# Altium schematic sheet Power.SchDoc
size 381 x 241 mm; SheetNumber: 1; SheetTotal: 2
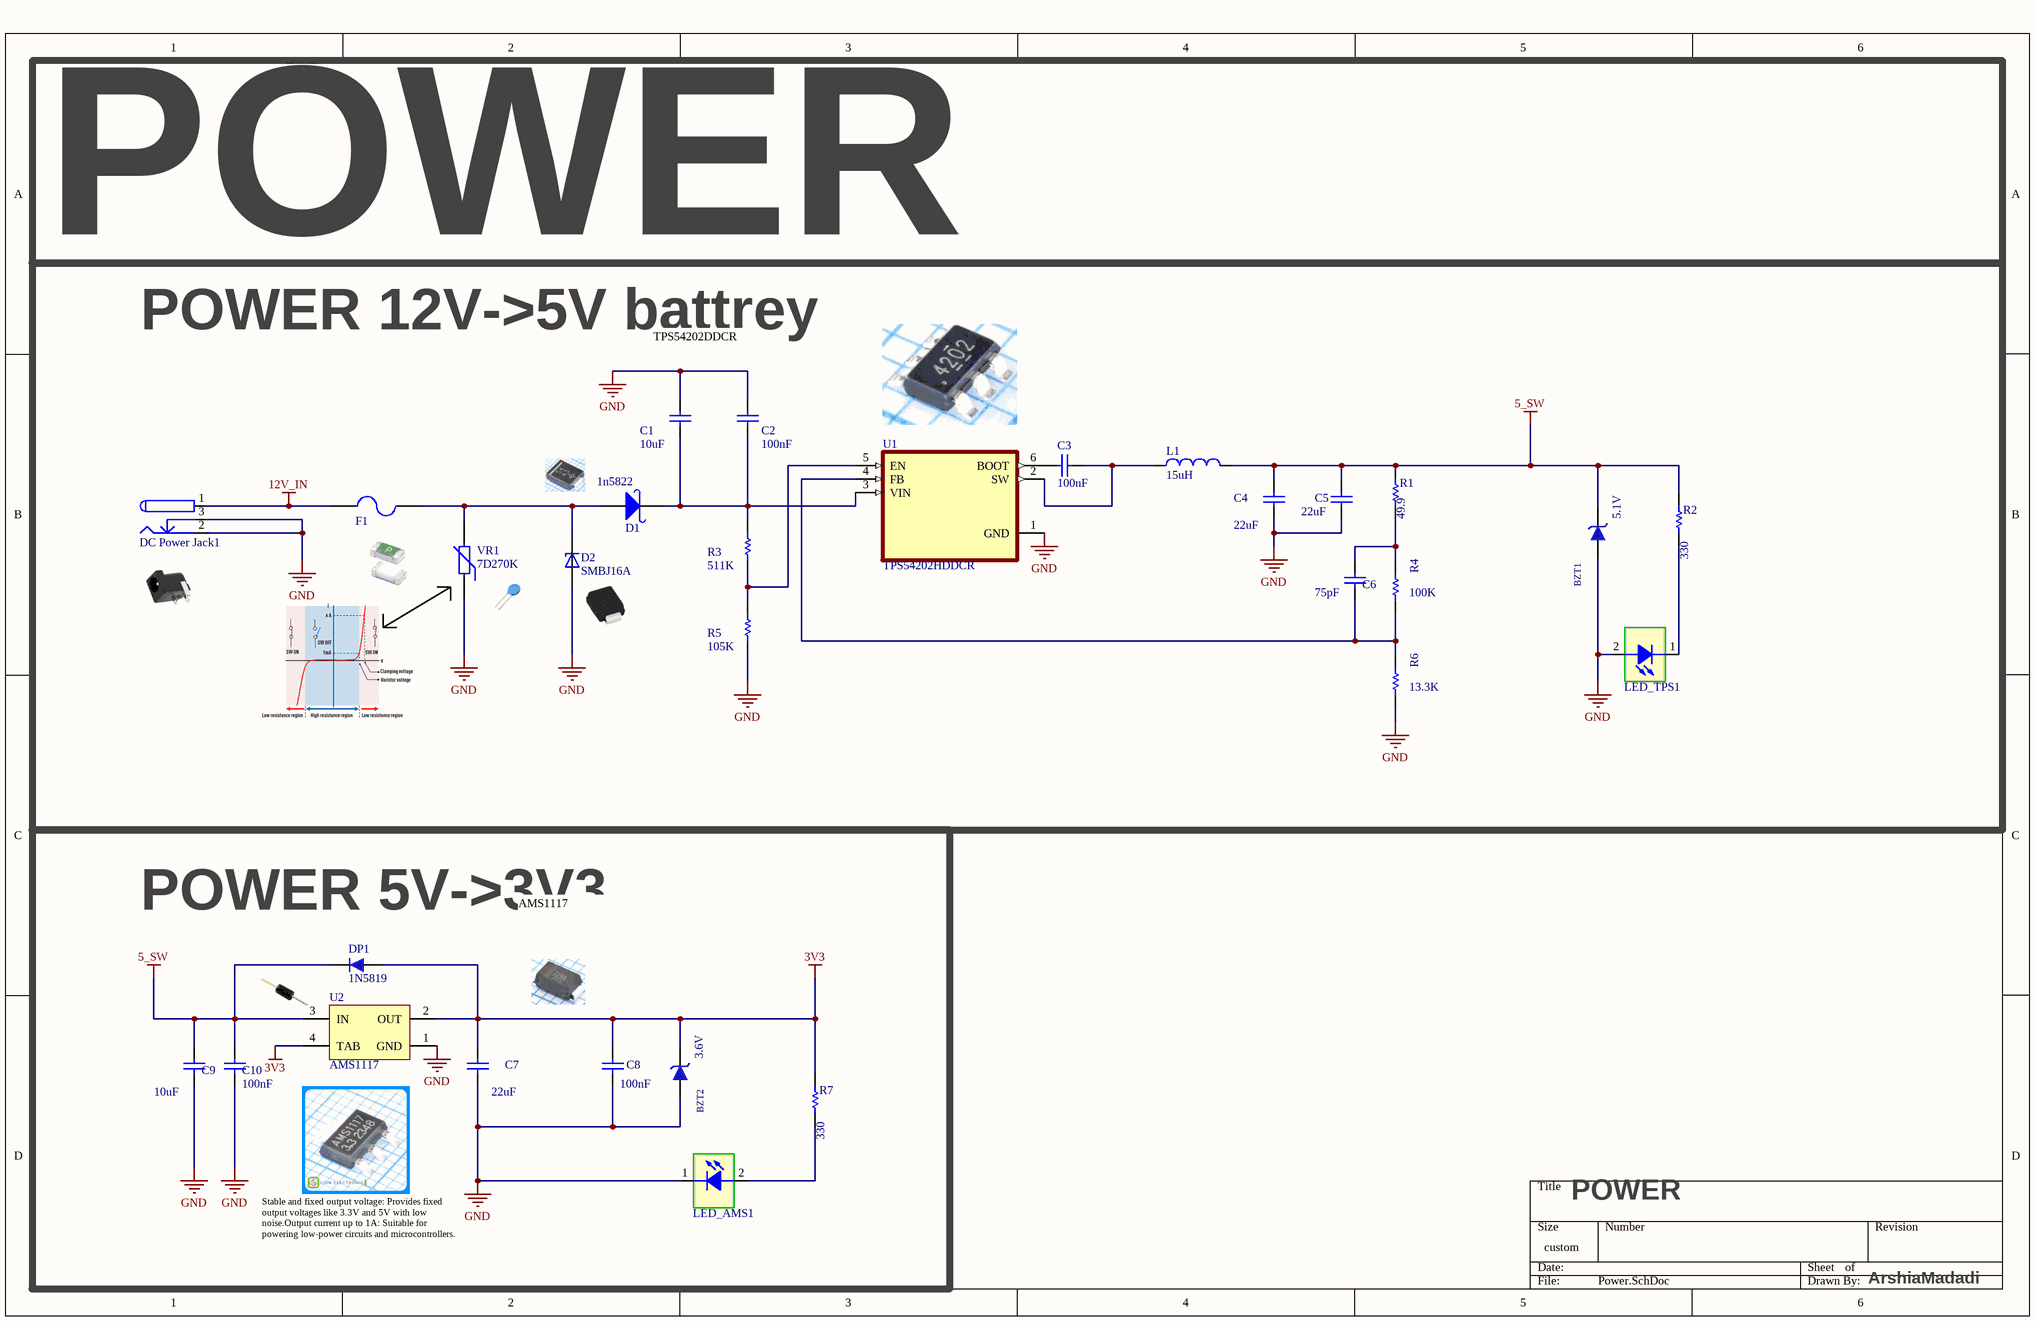
[diagram p0: Power.SchDoc]

## Parts
BZT1  5.1V  [SOD123]
BZT2  3.6V  [SOD123]
C1  10uF  [MY_CAP_SMD_0603]
C2  100nF  [MY_CAP_SMD_0603]
C3  100nF  [MY_CAP_SMD_0603]
C4  22uF  [MY_CAP_SMD_0603]
C5  22uF  [MY_CAP_SMD_0603]
C6  75pF  [MY_CAP_SMD_0603]
C7  22uF  [MY_CAP_SMD_0603]
C8  100nF  [MY_CAP_SMD_0603]
C9  10uF  [MY_CAP_SMD_0603]
C10  100nF  [MY_CAP_SMD_0603]
D1  1n5822  [DO-214AB(SMC)]
D2  SMBJ16A  [DIOM4336X265N]
DC_Power_Jack1  DC Power Jack  [DC Power Jack 1]  (value not drawn)
DP1  1N5819  [430X270D]
F1  F=3.0 A  [1206 FUSE]  (value not drawn)
L1  15uH  [INDUCTOR_SMD_3A]
LED_AMS1  SMD 1206 LED  [LED 1206]  (value not drawn)
LED_TPS1  SMD 1206 LED  [LED 1206]  (value not drawn)
R1  49.9  [RESC3413X04N]
R2  330  [RESC3413X04N]
R3  511K  [RESC3413X04N]
R4  100K  [RESC3413X04N]
R5  105K  [RESC3413X04N]
R6  13.3K  [RESC3413X04N]
R7  330  [RESC3413X04N]
U1  TPS54202HDDCR  [SOT95P280X110-6N]
U2  AMS1117  [SOT223_M]
VR1  7D270K  [07D XXX]

## Blocks framed on the sheet
POWER: BZT1 C1-C6 D1 D2 DC_Power_Jack1 F1 L1 LED_TPS1 R1-R6 U1 VR1
POWER 5V->3V3: BZT2 C7-C10 DP1 LED_AMS1 R7 U2

## Nets
3V3: BZT2.2 C7.1 C8.1 DP1.1 R7.2 U2.2(OUT) U2.4(TAB)
5_SW: BZT1.2 C4.1 C5.1 C9.1 C10.1 DP1.2 L1.2 R1.2 R2.2 U2.3(IN)
12V_IN: DC_Power_Jack1.1 F1.1
GND: BZT1.1 BZT2.1 C1.1 C2.1 C4.2 C5.2 C7.2 C8.2 C9.2 C10.2 D2.A DC_Power_Jack1.2 DC_Power_Jack1.3 LED_AMS1.1 LED_TPS1.2 R5.2 R6.2 U1.1(GND) U2.1(GND) VR1.1
NetC1_2: C1.2 C2.2 D1.2(K) R3.1 U1.3(VIN)
NetC3_1: C3.1 U1.6(BOOT)
NetC3_2: C3.2 L1.1 U1.2(SW)
NetC6_1: C6.1 R1.1 R4.1
NetC6_2: C6.2 R4.2 R6.1 U1.4(FB)
NetD1_1: D1.1(A) D2.C F1.2 VR1.2
NetLED_AMS1_2: LED_AMS1.2 R7.1
NetLED_TPS1_1: LED_TPS1.1 R2.1
NetR3_2: R3.2 R5.1 U1.5(EN)

## Notes on the sheet
- POWER 12V->5V battrey
- TPS54202DDCR
- AMS1117
- POWER
- Stable and fixed output voltage: Provides fixed output voltages like 3.3V and 5V with low noise.Output current up to 1A: Suitable for powering low-power circuits and microcontrollers.
- ArshiaMadadi

## Library data of the parts
BZT1 BZT2 = ZENER GENERAL DIODE: DIODE ZENER GENERAL; VALUE: 12V; Published: 2017-1-12; PackageVersion: 2017-1-12; PackageReference: DO 35; Publisher: Abbas Basereh; PackageDescription: DIODE GEN ZENER; ComponentLink1Description: Manufacturer Link; ComponentLink2Description: Datasheet
C1-C10 = CAP SMD_0603
D1 = 1N5822 SMD: Schottky Rectifiers; Part. No: SS34; Manufacturer: ON Semiconductor/Fairchild; Designer: Abbas Basereh; Link: https://www.aliexpress.com/item/Free-shipping-100pcs-1n5822-sma-smd-do-214ac-Schottky-diode-ss34/32337482329.html?spm=2114.01010208.3.1.zLZDsP&ws_ab_test=searchweb0_0,searchweb201602_4_10065_10068_10084_10083_10080_10082_10081_10060_10061_10062_10056_10055_10054_10059_10099_10078_10079_427_10073_10103_10102_10096_10052_10050_10051,searchweb201603_4&btsid=6e50dc92-ac69-45bc-a19e-209af19ce602; Link: http://www.tme.eu/en/details/ss34/smd-schottky-diodes/vishay/ss34-e357t/; Link: http://www.digikey.com/product-detail/en/on-semiconductor-fairchild/SS34/SS34FSCT-ND/2094459; Data: 16-12-2016
D2 = SMBJ16A: 600W, 18.8V, 5%, Unidirectional, TVS; MF: Taiwan Semiconductor; MP: SMBJ16A; SnapEDA_Link: https://www.snapeda.com/parts/SMBJ16A/Taiwan+Semiconductor/view-part/?ref=snap; Check_prices: https://www.snapeda.com/parts/SMBJ16A/Taiwan+Semiconductor/view-part/?ref=eda; Price: None; Availability: In Stock; Purchase-URL: https://pricing.snapeda.com/search/part/SMBJ16A/?ref=eda; Package: SMD-2-2 Avago; Value: *
DC_Power_Jack1 = DC Power Jack: DC Power Jack. Center Pin 2.5mm. Diameter: 5.7mm; Designer: Ali Hafizi; Company: Personal; Project Name: Laser; Adding Date: 10/21/2009
DP1 = 1N5819: Schottkey Rectifiers; Designer: Abbas Basereh; Data: 16-12-2016; Link: *; Part. No: *
F1 = Fuse SMD1206: SMD Fuses 1206; Designer: Abbas Basereh; Desc.: SMD Fuses 1206; Data: 16-12-2016
L1 = INDUCTOR_SMD_3A
LED_AMS1 LED_TPS1 = LED SMD 1206
R1-R7 = RES 0805 0.125W: RES 0805; Designer: Abbas Basereh; Desc.: RES SMD 0805; Data: 16-12-2016
U1 = TPS54202HDDCR: 4.5V to 28V Input, 2A Output, Synchronous Step-Down Voltage Converter 6-SOT-23-THIN -40 to 125; MF: Texas Instruments; MP: TPS54202HDDCR; Price: None; Availability: Good; Check_prices: https://www.snapeda.com/parts/TPS54202HDDCR/Texas%20Instruments/view-part/573706/?ref=eda; Package: SOT-23-THN-6 Texas Instruments; Purchase-URL: https://pricing.snapeda.com/search/part/TPS54202HDDCR/?ref=eda; SnapEDA_Link: https://www.snapeda.com/parts/TPS54202HDDCR/Texas%20Instruments/view-part/573706/?ref=snap; Value: *
U2 = AMS1117-x.x: x.x Volt, 800mA Low-Dropout Linear Regulator, 4-pin SOT-223; Designer: Ali Hafizi; Data: 16-12-2016
VR1 = VARISTOR (VDR): VARISTORS; Manufacturer: china-canada-philipina; Designer: Abbas Basereh; VALUE: xxDxxx; Models: MOV-VDR-COV; Data: 2017-1-5; Link: digikey.com; PUBLISHER: ABBAS BASEREH